# Altium schematic sheet SOC_PL_Banks_RTM_IO_MISC.SchDoc: Title
size 420 x 297 mm; Author: G.Kasprowicz; CompanyName: WUT ISE; DrawnBy: G.Kasprowicz; Organization: WUT ISE; Address1: PW ISE; Address2: Nowowiejska 15/19 00-665 Warsaw; Address3: gkasprow@gmail.com; DocumentNumber: 16; Revision: 2; SheetNumber: 16; SheetTotal: 40; ModifiedBy: -; CheckedDate: -; Title2: Title 2; DivGrp: WUT ISE; Designer: G.Kasprowicz; ModifiedDate: -; ProjectName: Sensor Box
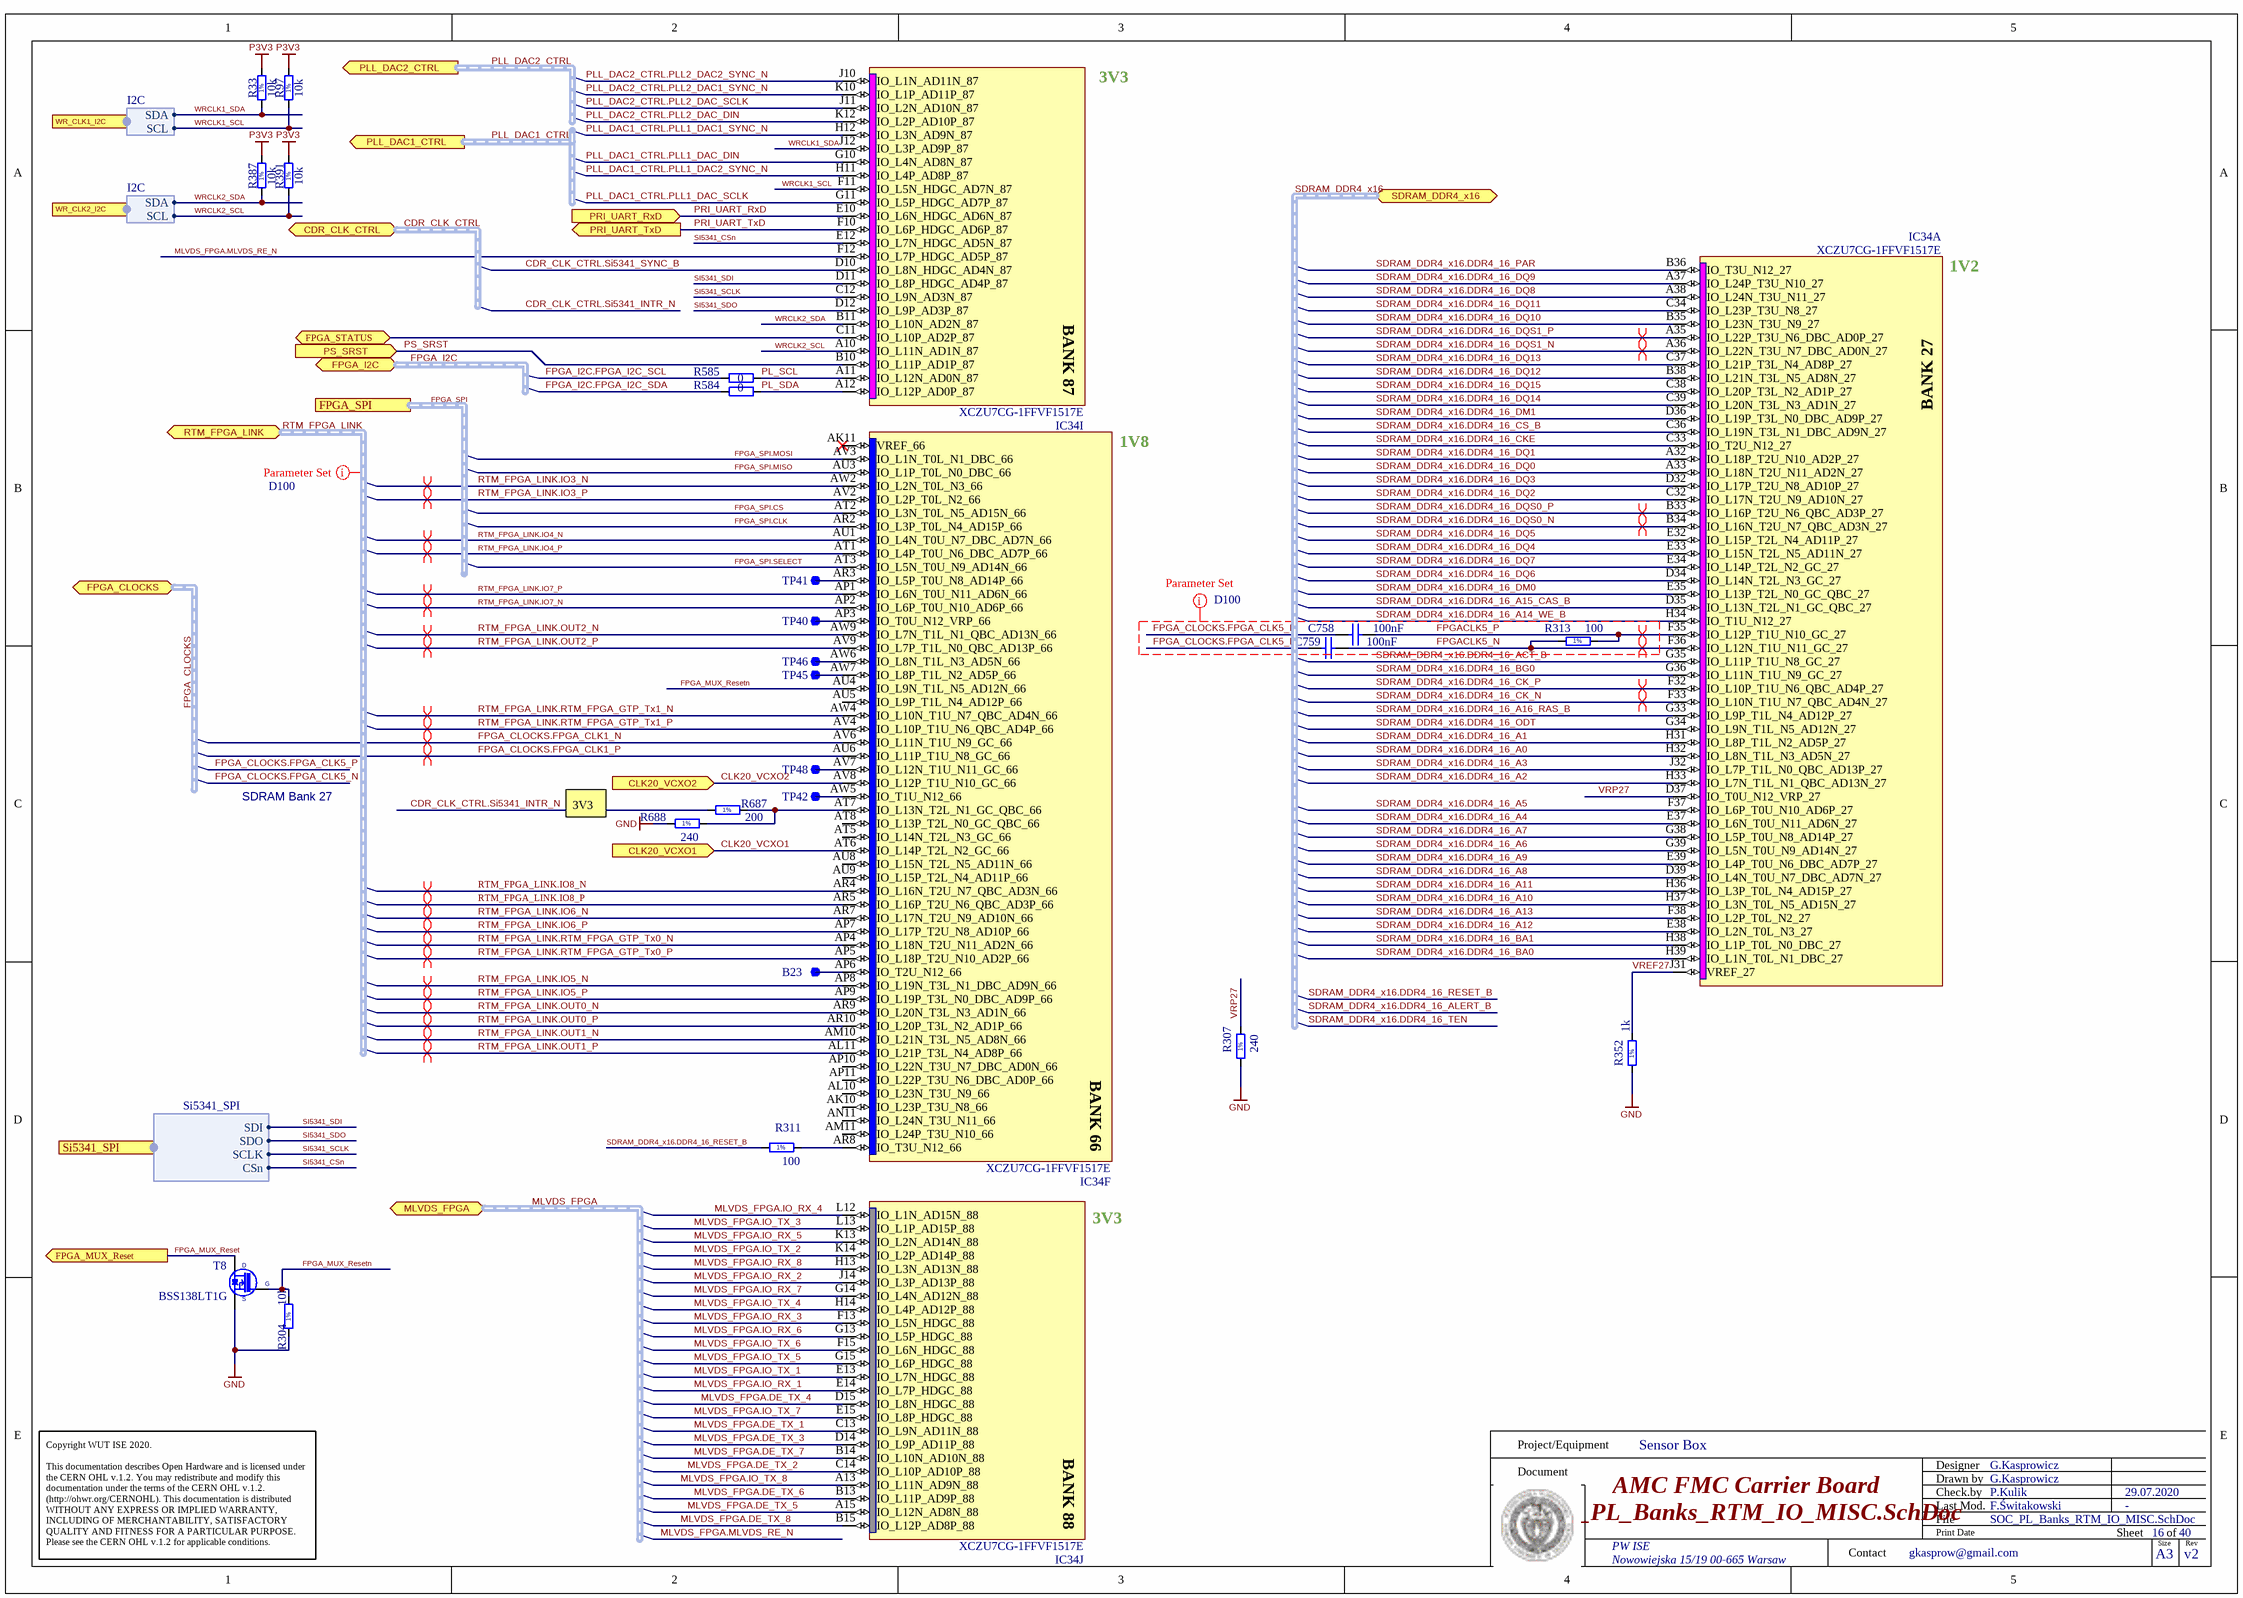
[diagram p0: SOC_PL_Banks_RTM_IO_MISC.SchDoc]

## Parts
B23  SMD Pad  [C100]  (value not drawn)  (no BOM)
C758  100nF  [CAPC0603X33N]
C759  100nF  [CAPC0603X33N]
IC34  XCZU7CG-1FFVF1517E  [BGA1517C100P39X39_4000X4000X351]  (parts A,F,I,J of 28)
R33  10k  [RESC1005X40N]
R97  10k  [RESC1005X40N]
R304  10k  [RESC1005X40N]
R307  240  [RESC1005X40N]
R311  100  [RESC1005X40N]
R313  100  [RESC1005X40N]
R352  1k  [RESC1005X40N]
R387  10k  [RESC1005X40N]
R391  10k  [RESC1005X40N]
R584  0  [RESC1005X40N]
R585  0  [RESC1005X40N]
R687  200  [RESC1005X40N]
R688  240  [RESC1005X40N]
T8  BSS138LT1G  [SOT95P240X110-3N]
TP40  SMD Pad  [C100]  (value not drawn)  (no BOM)
TP41  SMD Pad  [C100]  (value not drawn)  (no BOM)
TP42  SMD Pad  [C100]  (value not drawn)  (no BOM)
TP45  SMD Pad  [C100]  (value not drawn)  (no BOM)
TP46  SMD Pad  [C100]  (value not drawn)  (no BOM)
TP48  SMD Pad  [C100]  (value not drawn)  (no BOM)

## Ports
CDR_CLK_CTRL (bidir, harness CDR_CLK_CTRL), CLK20_VCXO1 (in), CLK20_VCXO2 (in), FPGA_CLOCKS (bidir, harness FPGA_CLOCKS), FPGA_I2C (bidir, harness FPGA_I2C), FPGA_MUX_Reset (out), FPGA_SPI (harness FPGA_SPI), FPGA_STATUS (bidir), MLVDS_FPGA (bidir, harness MLVDS_FPGA), PLL_DAC1_CTRL (out, harness PLL_DAC1_CTRL), PLL_DAC2_CTRL (out, harness PLL_DAC2_CTRL), PRI_UART_RxD (in), PRI_UART_TxD (out), PS_SRST (in), RTM_FPGA_LINK (bidir, harness RTM_FPGA_LINK), SDRAM_DDR4_x16 (bidir, harness SDRAM_DDR4_x16), Si5341_SPI (harness Si5341_SPI), WR_CLK1_I2C (harness I2C), WR_CLK2_I2C (harness I2C)

## Harnesses
I2C: SCL, SDA
Si5341_SPI: SDI, SCLK, CSn, SDO

## Nets
GND: R304.1 R307.1 R352.1 R688.1 T8.2(S)
P3V3: R33.2 R97.2 R387.2 R391.2
CDR_CLK_CTRL.Si5341_INTR_N: R687.1
CDR_CLK_CTRL.Si5341_SYNC_B: IC34.D10(IO_L8N_HDGC_AD4N_87)
CLK20_VCXO1: IC34.AT6(IO_L14P_T2L_N2_GC_66) ; port CLK20_VCXO1
CLK20_VCXO2: IC34.AV8(IO_L12P_T1U_N10_GC_66) ; port CLK20_VCXO2
FPGA_CLOCKS.FPGA_CLK1_N: IC34.AV6(IO_L11N_T1U_N9_GC_66)
FPGA_CLOCKS.FPGA_CLK1_P: IC34.AU6(IO_L11P_T1U_N8_GC_66)
FPGA_CLOCKS.FPGA_CLK5_N: C759.1
FPGA_CLOCKS.FPGA_CLK5_P: C758.1
FPGA_I2C.FPGA_I2C_SCL: R585.1
FPGA_I2C.FPGA_I2C_SDA: R584.1
FPGA_MUX_Reset: T8.3(D) ; port FPGA_MUX_Reset
FPGA_MUX_Resetn: IC34.AU4(IO_L9N_T1L_N5_AD12N_66) R304.2 T8.1(G)
FPGA_SPI.CLK: IC34.AR2(IO_L3P_T0L_N4_AD15P_66)
FPGA_SPI.CS: IC34.AT2(IO_L3N_T0L_N5_AD15N_66)
FPGA_SPI.MISO: IC34.AU3(IO_L1P_T0L_N0_DBC_66)
FPGA_SPI.MOSI: IC34.AV3(IO_L1N_T0L_N1_DBC_66)
FPGA_SPI.SELECT: IC34.AT3(IO_L5N_T0U_N9_AD14N_66)
FPGA_STATUS: IC34.C11(IO_L10P_AD2P_87) ; port FPGA_STATUS
FPGACLK5_N: C759.2 IC34.F36(IO_L12N_T1U_N11_GC_27) R313.1
FPGACLK5_P: C758.2 IC34.F35(IO_L12P_T1U_N10_GC_27) R313.2
MLVDS_FPGA.DE_TX_1: IC34.C13(IO_L9N_AD11N_88)
MLVDS_FPGA.DE_TX_2: IC34.C14(IO_L10P_AD10P_88)
MLVDS_FPGA.DE_TX_3: IC34.D14(IO_L9P_AD11P_88)
MLVDS_FPGA.DE_TX_4: IC34.D15(IO_L8N_HDGC_88)
MLVDS_FPGA.DE_TX_5: IC34.A15(IO_L12N_AD8N_88)
MLVDS_FPGA.DE_TX_6: IC34.B13(IO_L11P_AD9P_88)
MLVDS_FPGA.DE_TX_7: IC34.B14(IO_L10N_AD10N_88)
MLVDS_FPGA.DE_TX_8: IC34.B15(IO_L12P_AD8P_88)
MLVDS_FPGA.IO_RX_1: IC34.E14(IO_L7P_HDGC_88)
MLVDS_FPGA.IO_RX_2: IC34.J14(IO_L3P_AD13P_88)
MLVDS_FPGA.IO_RX_3: IC34.F13(IO_L5N_HDGC_88)
MLVDS_FPGA.IO_RX_4: IC34.L12(IO_L1N_AD15N_88)
MLVDS_FPGA.IO_RX_5: IC34.K13(IO_L2N_AD14N_88)
MLVDS_FPGA.IO_RX_6: IC34.G13(IO_L5P_HDGC_88)
MLVDS_FPGA.IO_RX_7: IC34.G14(IO_L4N_AD12N_88)
MLVDS_FPGA.IO_RX_8: IC34.H13(IO_L3N_AD13N_88)
MLVDS_FPGA.IO_TX_1: IC34.E13(IO_L7N_HDGC_88)
MLVDS_FPGA.IO_TX_2: IC34.K14(IO_L2P_AD14P_88)
MLVDS_FPGA.IO_TX_3: IC34.L13(IO_L1P_AD15P_88)
MLVDS_FPGA.IO_TX_4: IC34.H14(IO_L4P_AD12P_88)
MLVDS_FPGA.IO_TX_5: IC34.G15(IO_L6P_HDGC_88)
MLVDS_FPGA.IO_TX_6: IC34.F15(IO_L6N_HDGC_88)
MLVDS_FPGA.IO_TX_7: IC34.E15(IO_L8P_HDGC_88)
MLVDS_FPGA.IO_TX_8: IC34.A13(IO_L11N_AD9N_88)
MLVDS_FPGA.MLVDS_RE_N: IC34.F12(IO_L7P_HDGC_AD5P_87)
PL_SCL: IC34.A11(IO_L12N_AD0N_87) R585.2
PL_SDA: IC34.A12(IO_L12P_AD0P_87) R584.2
PLL_DAC1_CTRL.PLL1_DAC1_SYNC_N: IC34.H12(IO_L3N_AD9N_87)
PLL_DAC1_CTRL.PLL1_DAC2_SYNC_N: IC34.H11(IO_L4P_AD8P_87)
PLL_DAC1_CTRL.PLL1_DAC_DIN: IC34.G10(IO_L4N_AD8N_87)
PLL_DAC1_CTRL.PLL1_DAC_SCLK: IC34.G11(IO_L5P_HDGC_AD7P_87)
PLL_DAC2_CTRL.PLL2_DAC1_SYNC_N: IC34.K10(IO_L1P_AD11P_87)
PLL_DAC2_CTRL.PLL2_DAC2_SYNC_N: IC34.J10(IO_L1N_AD11N_87)
PLL_DAC2_CTRL.PLL2_DAC_DIN: IC34.K12(IO_L2P_AD10P_87)
PLL_DAC2_CTRL.PLL2_DAC_SCLK: IC34.J11(IO_L2N_AD10N_87)
PRI_UART_RxD: IC34.E10(IO_L6N_HDGC_AD6N_87) ; port PRI_UART_RxD
PRI_UART_TxD: IC34.F10(IO_L6P_HDGC_AD6P_87) ; port PRI_UART_TxD
PS_SRST: IC34.B10(IO_L11P_AD1P_87) ; port PS_SRST
RTM_FPGA_LINK.IO3_N: IC34.AW2(IO_L2N_T0L_N3_66)
RTM_FPGA_LINK.IO3_P: IC34.AV2(IO_L2P_T0L_N2_66)
RTM_FPGA_LINK.IO4_N: IC34.AU1(IO_L4N_T0U_N7_DBC_AD7N_66)
RTM_FPGA_LINK.IO4_P: IC34.AT1(IO_L4P_T0U_N6_DBC_AD7P_66)
RTM_FPGA_LINK.IO5_N: IC34.AP8(IO_L19N_T3L_N1_DBC_AD9N_66)
RTM_FPGA_LINK.IO5_P: IC34.AP9(IO_L19P_T3L_N0_DBC_AD9P_66)
RTM_FPGA_LINK.IO6_N: IC34.AR7(IO_L17N_T2U_N9_AD10N_66)
RTM_FPGA_LINK.IO6_P: IC34.AP7(IO_L17P_T2U_N8_AD10P_66)
RTM_FPGA_LINK.IO7_N: IC34.AP2(IO_L6P_T0U_N10_AD6P_66)
RTM_FPGA_LINK.IO7_P: IC34.AP1(IO_L6N_T0U_N11_AD6N_66)
RTM_FPGA_LINK.IO8_N: IC34.AR4(IO_L16N_T2U_N7_QBC_AD3N_66)
RTM_FPGA_LINK.IO8_P: IC34.AR5(IO_L16P_T2U_N6_QBC_AD3P_66)
RTM_FPGA_LINK.OUT0_N: IC34.AR9(IO_L20N_T3L_N3_AD1N_66)
RTM_FPGA_LINK.OUT0_P: IC34.AR10(IO_L20P_T3L_N2_AD1P_66)
RTM_FPGA_LINK.OUT1_N: IC34.AM10(IO_L21N_T3L_N5_AD8N_66)
RTM_FPGA_LINK.OUT1_P: IC34.AL11(IO_L21P_T3L_N4_AD8P_66)
RTM_FPGA_LINK.OUT2_N: IC34.AW9(IO_L7N_T1L_N1_QBC_AD13N_66)
RTM_FPGA_LINK.OUT2_P: IC34.AV9(IO_L7P_T1L_N0_QBC_AD13P_66)
RTM_FPGA_LINK.RTM_FPGA_GTP_Tx0_N: IC34.AP4(IO_L18N_T2U_N11_AD2N_66)
RTM_FPGA_LINK.RTM_FPGA_GTP_Tx0_P: IC34.AP5(IO_L18P_T2U_N10_AD2P_66)
RTM_FPGA_LINK.RTM_FPGA_GTP_Tx1_N: IC34.AW4(IO_L10N_T1U_N7_QBC_AD4N_66)
RTM_FPGA_LINK.RTM_FPGA_GTP_Tx1_P: IC34.AV4(IO_L10P_T1U_N6_QBC_AD4P_66)
SDRAM_DDR4_x16.DDR4_16_A0: IC34.H32(IO_L8N_T1L_N3_AD5N_27)
SDRAM_DDR4_x16.DDR4_16_A1: IC34.H31(IO_L8P_T1L_N2_AD5P_27)
SDRAM_DDR4_x16.DDR4_16_A2: IC34.H33(IO_L7N_T1L_N1_QBC_AD13N_27)
SDRAM_DDR4_x16.DDR4_16_A3: IC34.J32(IO_L7P_T1L_N0_QBC_AD13P_27)
SDRAM_DDR4_x16.DDR4_16_A4: IC34.E37(IO_L6N_T0U_N11_AD6N_27)
SDRAM_DDR4_x16.DDR4_16_A5: IC34.F37(IO_L6P_T0U_N10_AD6P_27)
SDRAM_DDR4_x16.DDR4_16_A6: IC34.G39(IO_L5N_T0U_N9_AD14N_27)
SDRAM_DDR4_x16.DDR4_16_A7: IC34.G38(IO_L5P_T0U_N8_AD14P_27)
SDRAM_DDR4_x16.DDR4_16_A8: IC34.D39(IO_L4N_T0U_N7_DBC_AD7N_27)
SDRAM_DDR4_x16.DDR4_16_A9: IC34.E39(IO_L4P_T0U_N6_DBC_AD7P_27)
SDRAM_DDR4_x16.DDR4_16_A10: IC34.H37(IO_L3N_T0L_N5_AD15N_27)
SDRAM_DDR4_x16.DDR4_16_A11: IC34.H36(IO_L3P_T0L_N4_AD15P_27)
SDRAM_DDR4_x16.DDR4_16_A12: IC34.E38(IO_L2N_T0L_N3_27)
SDRAM_DDR4_x16.DDR4_16_A13: IC34.F38(IO_L2P_T0L_N2_27)
SDRAM_DDR4_x16.DDR4_16_A14_WE_B: IC34.H34(IO_T1U_N12_27)
SDRAM_DDR4_x16.DDR4_16_A15_CAS_B: IC34.D35(IO_L13N_T2L_N1_GC_QBC_27)
SDRAM_DDR4_x16.DDR4_16_A16_RAS_B: IC34.G33(IO_L9P_T1L_N4_AD12P_27)
SDRAM_DDR4_x16.DDR4_16_ACT_B: IC34.G35(IO_L11P_T1U_N8_GC_27)
SDRAM_DDR4_x16.DDR4_16_BA0: IC34.H39(IO_L1N_T0L_N1_DBC_27)
SDRAM_DDR4_x16.DDR4_16_BA1: IC34.H38(IO_L1P_T0L_N0_DBC_27)
SDRAM_DDR4_x16.DDR4_16_BG0: IC34.G36(IO_L11N_T1U_N9_GC_27)
SDRAM_DDR4_x16.DDR4_16_CK_N: IC34.F33(IO_L10N_T1U_N7_QBC_AD4N_27)
SDRAM_DDR4_x16.DDR4_16_CK_P: IC34.F32(IO_L10P_T1U_N6_QBC_AD4P_27)
SDRAM_DDR4_x16.DDR4_16_CKE: IC34.C33(IO_T2U_N12_27)
SDRAM_DDR4_x16.DDR4_16_CS_B: IC34.C36(IO_L19N_T3L_N1_DBC_AD9N_27)
SDRAM_DDR4_x16.DDR4_16_DM0: IC34.E35(IO_L13P_T2L_N0_GC_QBC_27)
SDRAM_DDR4_x16.DDR4_16_DM1: IC34.D36(IO_L19P_T3L_N0_DBC_AD9P_27)
SDRAM_DDR4_x16.DDR4_16_DQ0: IC34.A33(IO_L18N_T2U_N11_AD2N_27)
SDRAM_DDR4_x16.DDR4_16_DQ1: IC34.A32(IO_L18P_T2U_N10_AD2P_27)
SDRAM_DDR4_x16.DDR4_16_DQ2: IC34.C32(IO_L17N_T2U_N9_AD10N_27)
SDRAM_DDR4_x16.DDR4_16_DQ3: IC34.D32(IO_L17P_T2U_N8_AD10P_27)
SDRAM_DDR4_x16.DDR4_16_DQ4: IC34.E33(IO_L15N_T2L_N5_AD11N_27)
SDRAM_DDR4_x16.DDR4_16_DQ5: IC34.E32(IO_L15P_T2L_N4_AD11P_27)
SDRAM_DDR4_x16.DDR4_16_DQ6: IC34.D34(IO_L14N_T2L_N3_GC_27)
SDRAM_DDR4_x16.DDR4_16_DQ7: IC34.E34(IO_L14P_T2L_N2_GC_27)
SDRAM_DDR4_x16.DDR4_16_DQ8: IC34.A38(IO_L24N_T3U_N11_27)
SDRAM_DDR4_x16.DDR4_16_DQ9: IC34.A37(IO_L24P_T3U_N10_27)
SDRAM_DDR4_x16.DDR4_16_DQ10: IC34.B35(IO_L23N_T3U_N9_27)
SDRAM_DDR4_x16.DDR4_16_DQ11: IC34.C34(IO_L23P_T3U_N8_27)
SDRAM_DDR4_x16.DDR4_16_DQ12: IC34.B38(IO_L21N_T3L_N5_AD8N_27)
SDRAM_DDR4_x16.DDR4_16_DQ13: IC34.C37(IO_L21P_T3L_N4_AD8P_27)
SDRAM_DDR4_x16.DDR4_16_DQ14: IC34.C39(IO_L20N_T3L_N3_AD1N_27)
SDRAM_DDR4_x16.DDR4_16_DQ15: IC34.C38(IO_L20P_T3L_N2_AD1P_27)
SDRAM_DDR4_x16.DDR4_16_DQS0_N: IC34.B34(IO_L16N_T2U_N7_QBC_AD3N_27)
SDRAM_DDR4_x16.DDR4_16_DQS0_P: IC34.B33(IO_L16P_T2U_N6_QBC_AD3P_27)
SDRAM_DDR4_x16.DDR4_16_DQS1_N: IC34.A36(IO_L22N_T3U_N7_DBC_AD0N_27)
SDRAM_DDR4_x16.DDR4_16_DQS1_P: IC34.A35(IO_L22P_T3U_N6_DBC_AD0P_27)
SDRAM_DDR4_x16.DDR4_16_ODT: IC34.G34(IO_L9N_T1L_N5_AD12N_27)
SDRAM_DDR4_x16.DDR4_16_PAR: IC34.B36(IO_T3U_N12_27)
SDRAM_DDR4_x16.DDR4_16_RESET_B: R311.1
SI5341_CSn: IC34.E12(IO_L7N_HDGC_AD5N_87) ; port Si5341_SPI.CSn
SI5341_SCLK: IC34.C12(IO_L9N_AD3N_87) ; port Si5341_SPI.SCLK
SI5341_SDI: IC34.D11(IO_L8P_HDGC_AD4P_87) ; port Si5341_SPI.SDI
SI5341_SDO: IC34.D12(IO_L9P_AD3P_87) ; port Si5341_SPI.SDO
VREF27: IC34.J31(VREF_27) R352.2
VRP27: IC34.D37(IO_T0U_N12_VRP_27) R307.2
WRCLK1_SCL: IC34.F11(IO_L5N_HDGC_AD7N_87) R97.1 ; port WR_CLK1_I2C.SCL
WRCLK1_SDA: IC34.J12(IO_L3P_AD9P_87) R33.1 ; port WR_CLK1_I2C.SDA
WRCLK2_SCL: IC34.A10(IO_L11N_AD1N_87) R391.1 ; port WR_CLK2_I2C.SCL
WRCLK2_SDA: IC34.B11(IO_L10N_AD2N_87) R387.1 ; port WR_CLK2_I2C.SDA
NetB23_1: B23.1 IC34.AP6(IO_T2U_N12_66)
NetIC34_AP3: IC34.AP3(IO_T0U_N12_VRP_66) TP40.1
NetIC34_AR3: IC34.AR3(IO_L5P_T0U_N8_AD14P_66) TP41.1
NetIC34_AR8: IC34.AR8(IO_T3U_N12_66) R311.2
NetIC34_AT7: IC34.AT7(IO_L13N_T2L_N1_GC_QBC_66) R687.2 R688.2
NetIC34_AV7: IC34.AV7(IO_L12N_T1U_N11_GC_66) TP48.1
NetIC34_AW5: IC34.AW5(IO_T1U_N12_66) TP42.1
NetIC34_AW6: IC34.AW6(IO_L8N_T1L_N3_AD5N_66) TP46.1
NetIC34_AW7: IC34.AW7(IO_L8P_T1L_N2_AD5P_66) TP45.1

Not connected (* = marked no-connect by the designer): IC34 AK10(IO_L23P_T3U_N8_66) AK11(VREF_66)* AL10(IO_L23N_T3U_N9_66) AM11(IO_L24P_T3U_N10_66) AN11(IO_L24N_T3U_N11_66) AP10(IO_L22N_T3U_N7_DBC_AD0N_66) AP11(IO_L22P_T3U_N6_DBC_AD0P_66) AT5(IO_L14N_T2L_N3_GC_66) AT8(IO_L13P_T2L_N0_GC_QBC_66) AU5(IO_L9P_T1L_N4_AD12P_66) AU8(IO_L15N_T2L_N5_AD11N_66) AU9(IO_L15P_T2L_N4_AD11P_66)

## Buses and harness runs
harness CDR_CLK_CTRL = port CDR_CLK_CTRL
harness FPGA_CLOCKS = port FPGA_CLOCKS
harness FPGA_I2C = port FPGA_I2C
harness FPGA_SPI = port FPGA_SPI
harness MLVDS_FPGA = port MLVDS_FPGA
harness PLL_DAC1_CTRL = port PLL_DAC1_CTRL
harness PLL_DAC2_CTRL = port PLL_DAC2_CTRL
harness RTM_FPGA_LINK = port RTM_FPGA_LINK
harness SDRAM_DDR4_x16 = port SDRAM_DDR4_x16

## Layout directives
differential pair: FPGA_CLOCKS.FPGA_CLK1_N, FPGA_CLOCKS.FPGA_CLK1_P, FPGACLK5_N, FPGACLK5_P, RTM_FPGA_LINK.IO3_N, RTM_FPGA_LINK.IO3_P, RTM_FPGA_LINK.IO4_N, RTM_FPGA_LINK.IO4_P, RTM_FPGA_LINK.IO5_N, RTM_FPGA_LINK.IO5_P, RTM_FPGA_LINK.IO6_N, RTM_FPGA_LINK.IO6_P, RTM_FPGA_LINK.IO7_N, RTM_FPGA_LINK.IO7_P, RTM_FPGA_LINK.IO8_N, RTM_FPGA_LINK.IO8_P, RTM_FPGA_LINK.OUT0_N, RTM_FPGA_LINK.OUT0_P, RTM_FPGA_LINK.OUT1_N, RTM_FPGA_LINK.OUT1_P, RTM_FPGA_LINK.OUT2_N, RTM_FPGA_LINK.OUT2_P, RTM_FPGA_LINK.RTM_FPGA_GTP_Tx0_N, RTM_FPGA_LINK.RTM_FPGA_GTP_Tx0_P, RTM_FPGA_LINK.RTM_FPGA_GTP_Tx1_N, RTM_FPGA_LINK.RTM_FPGA_GTP_Tx1_P, SDRAM_DDR4_x16.DDR4_16_CK_N, SDRAM_DDR4_x16.DDR4_16_CK_P, SDRAM_DDR4_x16.DDR4_16_DQS0_N, SDRAM_DDR4_x16.DDR4_16_DQS0_P, SDRAM_DDR4_x16.DDR4_16_DQS1_N, SDRAM_DDR4_x16.DDR4_16_DQS1_P
net class D100: (no net found under the mark), FPGA_CLOCKS.FPGA_CLK5_N, FPGA_CLOCKS.FPGA_CLK5_P, FPGACLK5_N, FPGACLK5_P, SDRAM_DDR4_x16.DDR4_16_A14_WE_B

## Notes on the sheet
- 3V3
- 1V2
- 1V8
- SDRAM Bank 27
- Project/Equipment
- Document
- AMC FMC Carrier Board
- Designer
- Drawn by
- Check.by
- P.Kulik
- 29.07.2020
- Copyright WUT ISE 2020.
  This documentation describes Open Hardware and is licensed under the CERN OHL v.1.2. You may redistribute and modify this documentation under the terms of the CERN OHL v.1.2. (http://ohwr.org/CERNOHL). This documentation is distributed WITHOUT ANY EXPRESS OR IMPLIED WARRANTY, INCLUDING OF MERCHANTABILITY, SATISFACTORY QUALITY AND FITNESS FOR A PARTICULAR PURPOSE. Please see the CERN OHL v.1.2 for applicable conditions.
- Contact
- File
- Last Mod.
- Print Date
- F.Świtakowski
- Sheet
- Size
- A3
- of
- v2
- Rev
- (in symbol R0402_1K_1%_0.0625W_100PPM) 1%
- (in symbol R0402_10K_1%_0.0625W_100PPM) 1%
- (in symbol R0402_100R_1%_0.1W_100PPM) 1%
- (in symbol R0402_200R_1%_0.0625W_100PPM) 1%
- (in symbol R0402_240R_1%_0.0625W_100PPM) 1%
- (in symbol XCZU7CG-1FFVF1517E, part A) BANK 27
- (in symbol XCZU7CG-1FFVF1517E, part F) BANK 66
- (in symbol XCZU7CG-1FFVF1517E, part I) BANK 87
- (in symbol XCZU7CG-1FFVF1517E, part J) BANK 88

## Library data of the parts
B23 TP40-TP42 TP45 TP46 TP48 = SMD_PAD_D1MM: Through Hole Pad; Part Description: 1mm Diameter SMD Pad; Mounted: No; PackageDescription: 1mm Diameter SMD Pad; Part Number: SMD_PAD_D1MM; Component Type: Standard (No BOM); Pin Count: 1; Family: SMD Pad; Socket: No; SMD: No; Sense: No; Status: None; ComponentHeight: 0mm; HelpURL: Undefined; Author: CERN DEM JLC; CreateDate: 10/10/2017; LatestRevisionDate: 10/10/2017
C758 C759 = CC0201_100NF_6.3V_10%_X5R: Non-polarised capacitor; Part Description: SMD Multilayer Chip Ceramic Capacitor; Manufacturer: GENERIC; Manufacturer1 Part Number: 02016D104KAT2A; Voltage: 6.3V; TC: X5R; Tolerance: ±10%; Part Number: CC0201_100NF_6.3V_10%_X5R; Component Kind: Standard; Component Type: Standard; Pin Count: 2; Value: 100nF; Status: Not Recommended; Manufacturer Part Number: CC0201_100NF_6.3V_10%_X5R; Case: 0201; Mounted: Yes; Socket: No; SMD: Yes; Sense: No; Manufacturer1 Example: AVX; Manufacturer1 ComponentHeight: 0.33mm; HelpURL: \\cern.ch\dfs\Applications\Altium\Datasheets\CC0201_X5R_AVX.pdf; Author: CERN DEM JLC; CreateDate: 03.12.2007; LatestRevisionDate: 03.12.2007
IC34 = XCZU7CG-1FFVF1517E: Zynq UltraScale+ RFSoC, Quad-Core ARM® Cortex™-A53 MPCore™ up to 1.5GHz, 214 PS I/O, 416 HP I/O, 48 HD I/O, 1517-Pin BGA; Part Description: Zynq UltraScale+ MPSoC, Quad-Core ARM® Cortex™-A53 MPCore™ up to 1.5GHz, 214 PS I/O, 416 HP I/O, 48 HD I/O, 1517-Pin BGA; Manufacturer: XILINX; PressFit: No; Bonding: No; Part Number: XCZU7CG-1FFVF1517E; Component Kind: Standard; Component Type: Standard; Device: XCZU7CG-1FFVF1517E; PackageDescription: BGA, 1.00mm Pitch, Square; 1517 Pin, 39 Columns X 39 Rows, Body 40.00mm X 40.00mm X 3.51mm H, IPC Medium Density; Manufacturer Part Number: XCZU7CG-1FFVF1517E; Pin Count: 1517; Case: BGA1517; Mounted: Yes; Socket: No; SMD: Yes; Sense: No; ComponentHeight: 3.51mm; HelpURL: \\cern.ch\dfs\Applications\Altium\Datasheets\XCZU7CG-1FFVF1517E.pdf; ComponentLink1URL: \\cern.ch\dfs\Applications\Altium\Datasheets\XCZU7CG-1FFVF1517E_Package-Pinout.pdf; ComponentLink1Description: Package/Pinout; ComponentLink2URL: \\cern.ch\dfs\Applications\Altium\Datasheets\XCZU7CG-1FFVF1517E_Pinout.pdf; ComponentLink2Description: Pinout; Author: CERN DEM BC; CreateDate: 10.07.2019; LatestRevisionDate: 10.07.2019
R33 R97 R304 R387 R391 = R0402_10K_1%_0.0625W_100PPM: Resistor - 1%; Part Description: General Purpose Thick Film Chip Resistor; Manufacturer: GENERIC; Manufacturer1 Part Number: 232270671003L; TC: ±100ppm/°C; PressFit: No; Part Number: R0402_10K_1%_0.0625W_100PPM; Component Kind: Standard; Component Type: Standard; Pin Count: 2; Value: 10k; Status: Not Recommended; Power: 0.0625W; Tolerance: ±1%; Manufacturer Part Number: R0402_10K_1%_0.0625W_100PPM; Case: 0402; Mounted: Yes; Sense: No; Socket: No; SMD: Yes; Manufacturer1 Example: YAGEO PHYCOMP; Manufacturer1 ComponentHeight: 0.4mm; HelpURL: \\cern.ch\dfs\Applications\Altium\Datasheets\R0402_Phycomp_RC0402.pdf; Author: CERN DEM JLC; CreateDate: 03.12.2007; LatestRevisionDate: 17.10.2012
R307 R688 = R0402_240R_1%_0.0625W_100PPM: Resistor - 1%; Manufacturer: GENERIC; Part Description: General Purpose Thick Film Chip Resistor; Manufacturer1 Part Number: 232270672401L; TC: ±100ppm/°C; PressFit: No; Manufacturer Part Number: R0402_240R_1%_0.0625W_100PPM; Part Number: R0402_240R_1%_0.0625W_100PPM; Tolerance: ±1%; Value: 240; Component Kind: Standard; Component Type: Standard; Pin Count: 2; Status: Not Recommended; Power: 0.0625W; Case: 0402; Mounted: Yes; Sense: No; Socket: No; SMD: Yes; Manufacturer1 Example: YAGEO PHYCOMP; Manufacturer1 ComponentHeight: 0.4mm; HelpURL: \\cern.ch\dfs\Applications\Altium\Datasheets\R0402_Phycomp_RC0402.pdf; Author: CERN DEM JLC; CreateDate: 03/12/2007; LatestRevisionDate: 17/10/2012
R311 R313 = R0402_100R_1%_0.1W_100PPM: Resistor - 1%; Manufacturer Part Number: R0402_100R_1%_0.1W_100PPM_50V; Manufacturer: GENERIC; Part Description: General Purpose Thick Film Chip Resistor; Manufacturer1 Part Number: ERJ2RKF1000X; Power: 0.1W; TC: ±100ppm/°C; Voltage: 50V; PressFit: No; Part Number: R0402_100R_1%_0.1W_100PPM; Tolerance: ±1%; Value: 100; Component Kind: Standard; Component Type: Standard; Pin Count: 2; Status: Not Recommended; Case: 0402; Mounted: Yes; Sense: No; Socket: No; SMD: Yes; Manufacturer1 Example: PANASONIC; Manufacturer1 ComponentHeight: 0.4mm; HelpURL: \\cern.ch\dfs\Applications\Altium\Datasheets\R0402_PANASONIC_ERJ2RK.pdf; Author: CERN DEM JLC; CreateDate: 12/12/2013; LatestRevisionDate: 03/03/2015
R352 = R0402_1K_1%_0.0625W_100PPM: Resistor - 1%; Manufacturer: GENERIC; Part Description: General Purpose Thick Film Chip Resistor; Manufacturer1 Part Number: 232270671002L; TC: ±100ppm/°C; PressFit: No; Manufacturer Part Number: R0402_1K_1%_0.0625W_100PPM; Part Number: R0402_1K_1%_0.0625W_100PPM; Tolerance: ±1%; Value: 1k; Component Kind: Standard; Component Type: Standard; Pin Count: 2; Status: Not Recommended; Power: 0.0625W; Case: 0402; Mounted: Yes; Sense: No; Socket: No; SMD: Yes; Manufacturer1 Example: YAGEO PHYCOMP; Manufacturer1 ComponentHeight: 0.4mm; HelpURL: \\cern.ch\dfs\Applications\Altium\Datasheets\R0402_Phycomp_RC0402.pdf; Author: CERN DEM JLC; CreateDate: 03/12/2007; LatestRevisionDate: 17/10/2012
R584 R585 = R0402_0R_JUMPER: Resistor; Part Description: 1A (0.05R Max DC Resistance) Zero Ohm Jumper; Manufacturer: GENERIC; Manufacturer1 Part Number: 232270591001L; PressFit: No; Part Number: R0402_0R_JUMPER; Component Kind: Standard; Component Type: Standard; Pin Count: 2; Value: 0; Status: Not Recommended; Manufacturer Part Number: R0402_0R_JUMPER; Case: 0402; Mounted: Yes; Sense: No; Socket: No; SMD: Yes; Manufacturer1 Example: YAGEO PHYCOMP; Manufacturer1 ComponentHeight: 0.4mm; HelpURL: \\cern.ch\dfs\Applications\Altium\Datasheets\R0402_Phycomp_RC0402.pdf; Author: CERN DEM JLC; CreateDate: 03.12.2007; LatestRevisionDate: 17.10.2012
R687 = R0402_200R_1%_0.0625W_100PPM: Resistor - 1%; Part Description: General Purpose Thick Film Chip Resistor; Manufacturer: GENERIC; Manufacturer1 Part Number: 232270672001L; TC: ±100ppm/°C; PressFit: No; Part Number: R0402_200R_1%_0.0625W_100PPM; Component Kind: Standard; Component Type: Standard; Pin Count: 2; Value: 200; Status: Not Recommended; Power: 0.0625W; Tolerance: ±1%; Manufacturer Part Number: R0402_200R_1%_0.0625W_100PPM; Case: 0402; Mounted: Yes; Sense: No; Socket: No; SMD: Yes; Manufacturer1 Example: YAGEO PHYCOMP; Manufacturer1 ComponentHeight: 0.4mm; HelpURL: \\cern.ch\dfs\Applications\Altium\Datasheets\R0402_Phycomp_RC0402.pdf; Author: CERN DEM JLC; CreateDate: 03.12.2007; LatestRevisionDate: 17.10.2012
T8 = BSS138LT1G: N-CHANNEL MOSFET WITH DIODE; Manufacturer: ON SEMICONDUCTOR; Part Description: 50V 200mA N-Channel Enhancement Mode Field-Effect Transistor; PressFit: No; Bonding: No; Manufacturer Part Number: BSS138LT1G; PackageDescription: SOT23 3-Leads, Pitch 0.95mm - Body 1.4x3mm, IPC Medium Density; Part Number: BSS138LT1G; Component Kind: Standard; Component Type: Standard; Device: BSS138LT1G; Pin Count: 3; Case: SOT23-3; Mounted: Yes; Socket: No; SMD: Yes; Sense: No; ComponentHeight: 1.11mm; HelpURL: \\cern.ch\dfs\Applications\Altium\Datasheets\BSS138LT1G.pdf; Author: CERN DEM JLC; CreateDate: 23/03/2009; LatestRevisionDate: 23/03/2009